# Altium schematic sheet RGB_Breakout.SchDoc: Apalis Evaluation Board 1.1
size A3; Organization: Toradex AG; Address1: Altsagenstrasse 5; Address2: Horw; Address3: 6048; Address4: Switzerland; DocumentNumber: 17; Revision: V1.1; SheetNumber: 17; SheetTotal: 32; PageSetup: Record=PageOptions|CenterHorizontal=True|CenterVertical=True|PrintScale=0.73|XCorrection=1.00|YCorrection=1.00|PrintKind=0|BorderSize=5000000|LeftOffset=0|BottomOffset=0|Orientation=2|PaperLength=1000|PaperWidth=1000|Scale=100|PaperSource=7|PrintQuality=-4|MediaType=1|DitherType=10|PaperKind=A4|PrintScaleMode=1
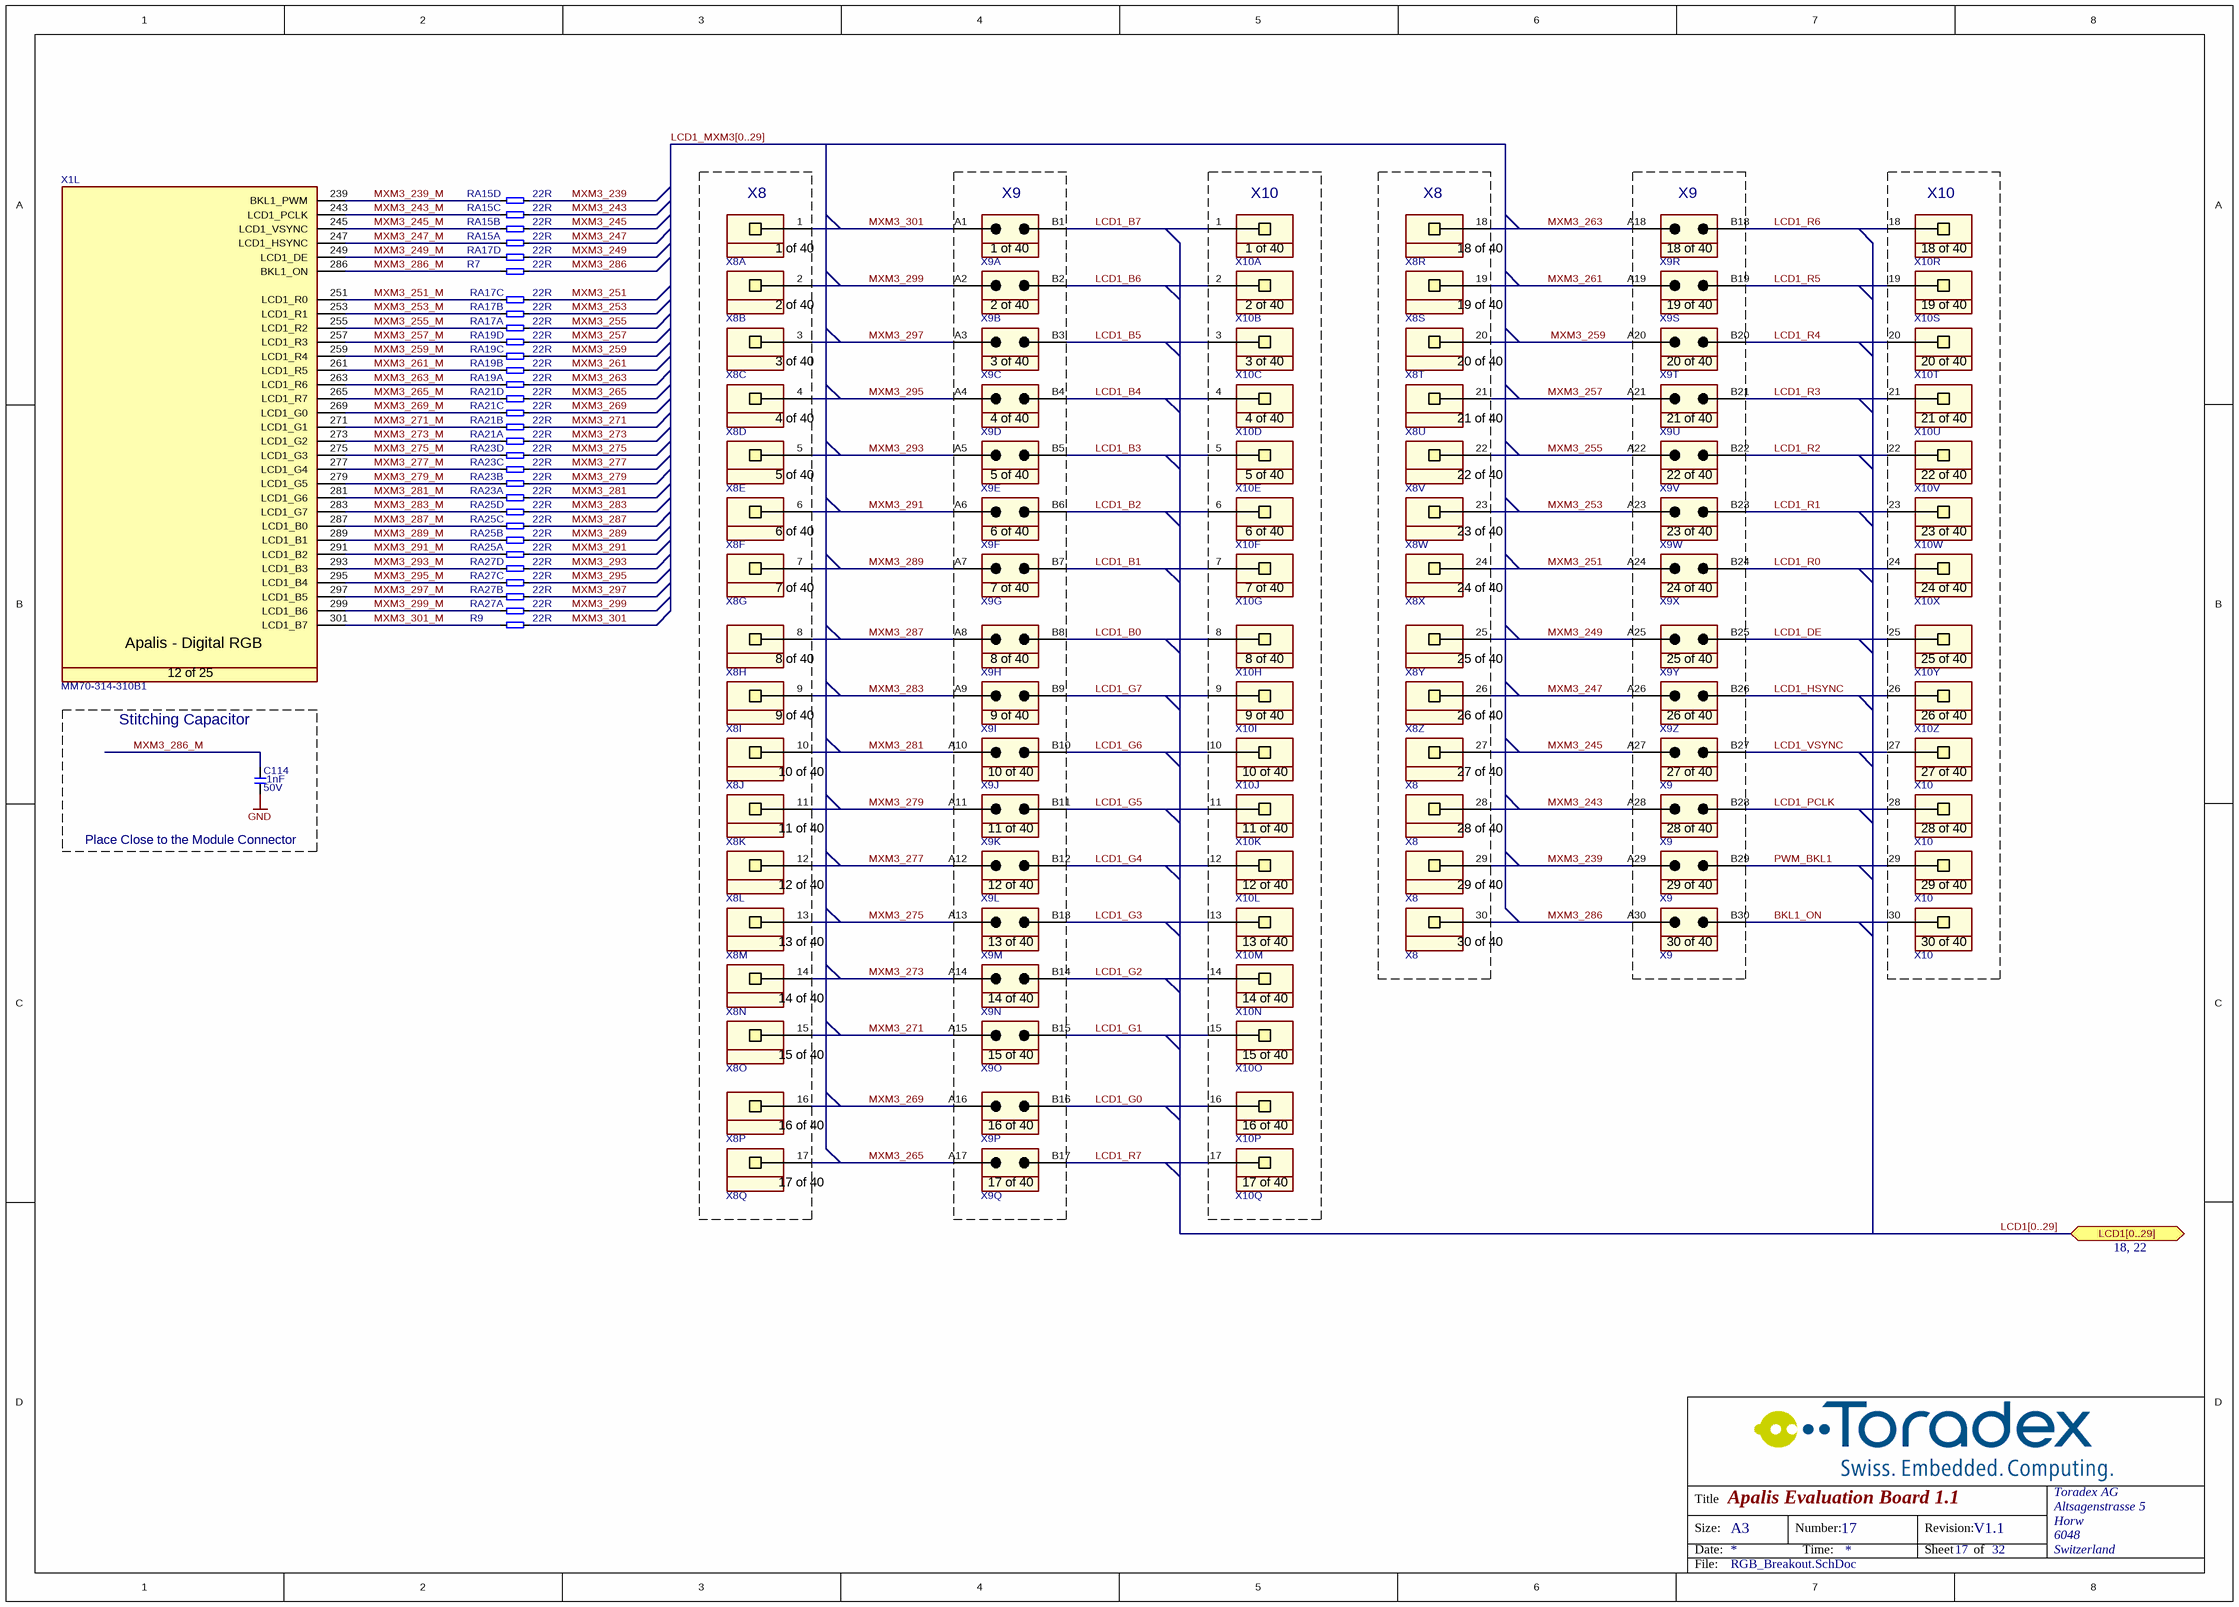
[diagram p0: RGB_Breakout.SchDoc]

## Parts
C114  Rating: 50V  [CAPC1005X60N]  (hidden comment: 1nF)
R7  22R  [RESC1005X40N]
R9  22R  [T_RESC0603X30N]
RA15  22R  [T_Resistor_Array_X4]  (parts A,B,C,D of 4)
RA17  22R  [T_Resistor_Array_X4]  (parts A,B,C,D of 4)
RA19  22R  [T_Resistor_Array_X4]  (parts A,B,C,D of 4)
RA21  22R  [T_Resistor_Array_X4]  (parts A,B,C,D of 4)
RA23  22R  [T_Resistor_Array_X4]  (parts A,B,C,D of 4)
RA25  22R  [T_Resistor_Array_X4]  (parts A,B,C,D of 4)
RA27  22R  [T_Resistor_Array_X4]  (parts A,B,C,D of 4)
X1  Manufacturer Part No.: MM70-314-310B1  [T_JAE_MM70-314-310B1]  (hidden comment: CON-JAE-MM70-314-310B1-314-0.5mm)  (part L of 25)
X8  SSW-110-01-G-S  [T_Samtec_SSW-110-01-G-S]  (value not drawn)  (parts A,B,C,D,E,F,G,H,I,J,K,L,M,N,O,P,Q,R,S,T,U,V,W,X,Y,Z,27,28,29,30 of 40)
X9  TSW-110-07-G-D  [T_Samtec_TSW-110-07-G-D]  (value not drawn)  (parts A,B,C,D,E,F,G,H,I,J,K,L,M,N,O,P,Q,R,S,T,U,V,W,X,Y,Z,27,28,29,30 of 40)
X10  SSW-110-01-G-S  [T_Samtec_SSW-110-01-G-S]  (value not drawn)  (parts A,B,C,D,E,F,G,H,I,J,K,L,M,N,O,P,Q,R,S,T,U,V,W,X,Y,Z,27,28,29,30 of 40)

## Blocks framed on the sheet
X8: X8
X9: X9
X10: X10
X8: X8
X9: X9
X10: X10
Stitching Capacitor: C114

## Ports
LCD1[0..29] (bidir, see 18, 22)

## Nets
GND: C114.1
BKL1_ON: X9.B30 X10.30
LCD1_B0: X9.B8 X10.8
LCD1_B1: X9.B7 X10.7
LCD1_B2: X9.B6 X10.6
LCD1_B3: X9.B5 X10.5
LCD1_B4: X9.B4 X10.4
LCD1_B5: X9.B3 X10.3
LCD1_B6: X9.B2 X10.2
LCD1_B7: X9.B1 X10.1
LCD1_DE: X9.B25 X10.25
LCD1_G0: X9.B16 X10.16
LCD1_G1: X9.B15 X10.15
LCD1_G2: X9.B14 X10.14
LCD1_G3: X9.B13 X10.13
LCD1_G4: X9.B12 X10.12
LCD1_G5: X9.B11 X10.11
LCD1_G6: X9.B10 X10.10
LCD1_G7: X9.B9 X10.9
LCD1_HSYNC: X9.B26 X10.26
LCD1_PCLK: X9.B28 X10.28
LCD1_R0: X9.B24 X10.24
LCD1_R1: X9.B23 X10.23
LCD1_R2: X9.B22 X10.22
LCD1_R3: X9.B21 X10.21
LCD1_R4: X9.B20 X10.20
LCD1_R5: X9.B19 X10.19
LCD1_R6: X9.B18 X10.18
LCD1_R7: X9.B17 X10.17
LCD1_VSYNC: X9.B27 X10.27
MXM3_239: RA15.8 X8.29 X9.A29
MXM3_239_M: RA15.4 X1.239(BKL1_PWM)
MXM3_243: RA15.7 X8.28 X9.A28
MXM3_243_M: RA15.3 X1.243(LCD1_PCLK)
MXM3_245: RA15.6 X8.27 X9.A27
MXM3_245_M: RA15.2 X1.245(LCD1_VSYNC)
MXM3_247: RA15.5 X8.26 X9.A26
MXM3_247_M: RA15.1 X1.247(LCD1_HSYNC)
MXM3_249: RA17.8 X8.25 X9.A25
MXM3_249_M: RA17.4 X1.249(LCD1_DE)
MXM3_251: RA17.7 X8.24 X9.A24
MXM3_251_M: RA17.3 X1.251(LCD1_R0)
MXM3_253: RA17.6 X8.23 X9.A23
MXM3_253_M: RA17.2 X1.253(LCD1_R1)
MXM3_255: RA17.5 X8.22 X9.A22
MXM3_255_M: RA17.1 X1.255(LCD1_R2)
MXM3_257: RA19.8 X8.21 X9.A21
MXM3_257_M: RA19.4 X1.257(LCD1_R3)
MXM3_259: RA19.7 X8.20 X9.A20
MXM3_259_M: RA19.3 X1.259(LCD1_R4)
MXM3_261: RA19.6 X8.19 X9.A19
MXM3_261_M: RA19.2 X1.261(LCD1_R5)
MXM3_263: RA19.5 X8.18 X9.A18
MXM3_263_M: RA19.1 X1.263(LCD1_R6)
MXM3_265: RA21.8 X8.17 X9.A17
MXM3_265_M: RA21.4 X1.265(LCD1_R7)
MXM3_269: RA21.7 X8.16 X9.A16
MXM3_269_M: RA21.3 X1.269(LCD1_G0)
MXM3_271: RA21.6 X8.15 X9.A15
MXM3_271_M: RA21.2 X1.271(LCD1_G1)
MXM3_273: RA21.5 X8.14 X9.A14
MXM3_273_M: RA21.1 X1.273(LCD1_G2)
MXM3_275: RA23.8 X8.13 X9.A13
MXM3_275_M: RA23.4 X1.275(LCD1_G3)
MXM3_277: RA23.7 X8.12 X9.A12
MXM3_277_M: RA23.3 X1.277(LCD1_G4)
MXM3_279: RA23.6 X8.11 X9.A11
MXM3_279_M: RA23.2 X1.279(LCD1_G5)
MXM3_281: RA23.5 X8.10 X9.A10
MXM3_281_M: RA23.1 X1.281(LCD1_G6)
MXM3_283: RA25.8 X8.9 X9.A9
MXM3_283_M: RA25.4 X1.283(LCD1_G7)
MXM3_286: R7.2 X8.30 X9.A30
MXM3_286_M: C114.2 R7.1 X1.286(BKL1_ON)
MXM3_287: RA25.7 X8.8 X9.A8
MXM3_287_M: RA25.3 X1.287(LCD1_B0)
MXM3_289: RA25.6 X8.7 X9.A7
MXM3_289_M: RA25.2 X1.289(LCD1_B1)
MXM3_291: RA25.5 X8.6 X9.A6
MXM3_291_M: RA25.1 X1.291(LCD1_B2)
MXM3_293: RA27.8 X8.5 X9.A5
MXM3_293_M: RA27.4 X1.293(LCD1_B3)
MXM3_295: RA27.7 X8.4 X9.A4
MXM3_295_M: RA27.3 X1.295(LCD1_B4)
MXM3_297: RA27.6 X8.3 X9.A3
MXM3_297_M: RA27.2 X1.297(LCD1_B5)
MXM3_299: RA27.5 X8.2 X9.A2
MXM3_299_M: RA27.1 X1.299(LCD1_B6)
MXM3_301: R9.2 X8.1 X9.A1
MXM3_301_M: R9.1 X1.301(LCD1_B7)
PWM_BKL1: X9.B29 X10.29

## Buses and harness runs
bus LCD1[0..29] = port LCD1[0..29]
bus LCD1_MXM3[0..29]

## Notes on the sheet
- (near C114) Place Close to the Module Connector
- Title
- Size:
- Date:
- A3
- Number:
- Time:
- Revision:
- Sheet
- of
- File:
- (in symbol CON-JAE-MM70-314-310B1-314-0.5mm, part L) Apalis - Digital RGB; 12 of 25
- (in symbol CON-Samtec-SSW-110-01-G-S, part A) 1 of 40
- (in symbol CON-Samtec-SSW-110-01-G-S, part B) 2 of 40
- (in symbol CON-Samtec-SSW-110-01-G-S, part C) 3 of 40
- (in symbol CON-Samtec-SSW-110-01-G-S, part D) 4 of 40
- (in symbol CON-Samtec-SSW-110-01-G-S, part E) 5 of 40
- (in symbol CON-Samtec-SSW-110-01-G-S, part F) 6 of 40
- (in symbol CON-Samtec-SSW-110-01-G-S, part G) 7 of 40
- (in symbol CON-Samtec-SSW-110-01-G-S, part H) 8 of 40
- (in symbol CON-Samtec-SSW-110-01-G-S, part I) 9 of 40
- (in symbol CON-Samtec-SSW-110-01-G-S, part J) 10 of 40
- (in symbol CON-Samtec-SSW-110-01-G-S, part K) 11 of 40
- (in symbol CON-Samtec-SSW-110-01-G-S, part L) 12 of 40
- (in symbol CON-Samtec-SSW-110-01-G-S, part M) 13 of 40
- (in symbol CON-Samtec-SSW-110-01-G-S, part N) 14 of 40
- (in symbol CON-Samtec-SSW-110-01-G-S, part O) 15 of 40
- (in symbol CON-Samtec-SSW-110-01-G-S, part P) 16 of 40
- (in symbol CON-Samtec-SSW-110-01-G-S, part Q) 17 of 40
- (in symbol CON-Samtec-SSW-110-01-G-S, part R) 18 of 40
- (in symbol CON-Samtec-SSW-110-01-G-S, part S) 19 of 40
- (in symbol CON-Samtec-SSW-110-01-G-S, part T) 20 of 40
- (in symbol CON-Samtec-SSW-110-01-G-S, part U) 21 of 40
- (in symbol CON-Samtec-SSW-110-01-G-S, part V) 22 of 40
- (in symbol CON-Samtec-SSW-110-01-G-S, part W) 23 of 40
- (in symbol CON-Samtec-SSW-110-01-G-S, part X) 24 of 40
- (in symbol CON-Samtec-SSW-110-01-G-S, part Y) 25 of 40
- (in symbol CON-Samtec-SSW-110-01-G-S, part Z) 26 of 40
- (in symbol CON-Samtec-SSW-110-01-G-S, part 27) 27 of 40
- (in symbol CON-Samtec-SSW-110-01-G-S, part 28) 28 of 40
- (in symbol CON-Samtec-SSW-110-01-G-S, part 29) 29 of 40
- (in symbol CON-Samtec-SSW-110-01-G-S, part 30) 30 of 40
- (in symbol CON-Samtec-TSW-110-07-G-D, part A) 1 of 40
- (in symbol CON-Samtec-TSW-110-07-G-D, part B) 2 of 40
- (in symbol CON-Samtec-TSW-110-07-G-D, part C) 3 of 40
- (in symbol CON-Samtec-TSW-110-07-G-D, part D) 4 of 40
- (in symbol CON-Samtec-TSW-110-07-G-D, part E) 5 of 40
- (in symbol CON-Samtec-TSW-110-07-G-D, part F) 6 of 40
- (in symbol CON-Samtec-TSW-110-07-G-D, part G) 7 of 40
- (in symbol CON-Samtec-TSW-110-07-G-D, part H) 8 of 40
- (in symbol CON-Samtec-TSW-110-07-G-D, part I) 9 of 40
- (in symbol CON-Samtec-TSW-110-07-G-D, part J) 10 of 40
- (in symbol CON-Samtec-TSW-110-07-G-D, part K) 11 of 40
- (in symbol CON-Samtec-TSW-110-07-G-D, part L) 12 of 40
- (in symbol CON-Samtec-TSW-110-07-G-D, part M) 13 of 40
- (in symbol CON-Samtec-TSW-110-07-G-D, part N) 14 of 40
- (in symbol CON-Samtec-TSW-110-07-G-D, part O) 15 of 40
- (in symbol CON-Samtec-TSW-110-07-G-D, part P) 16 of 40
- (in symbol CON-Samtec-TSW-110-07-G-D, part Q) 17 of 40
- (in symbol CON-Samtec-TSW-110-07-G-D, part R) 18 of 40
- (in symbol CON-Samtec-TSW-110-07-G-D, part S) 19 of 40
- (in symbol CON-Samtec-TSW-110-07-G-D, part T) 20 of 40
- (in symbol CON-Samtec-TSW-110-07-G-D, part U) 21 of 40
- (in symbol CON-Samtec-TSW-110-07-G-D, part V) 22 of 40
- (in symbol CON-Samtec-TSW-110-07-G-D, part W) 23 of 40
- (in symbol CON-Samtec-TSW-110-07-G-D, part X) 24 of 40
- (in symbol CON-Samtec-TSW-110-07-G-D, part Y) 25 of 40
- (in symbol CON-Samtec-TSW-110-07-G-D, part Z) 26 of 40
- (in symbol CON-Samtec-TSW-110-07-G-D, part 27) 27 of 40
- (in symbol CON-Samtec-TSW-110-07-G-D, part 28) 28 of 40
- (in symbol CON-Samtec-TSW-110-07-G-D, part 29) 29 of 40
- (in symbol CON-Samtec-TSW-110-07-G-D, part 30) 30 of 40

## Library data of the parts
C114 = C-X7R-1nF-50V-10%-0402: Capacitor Ceramic X7R 1nF 50V 10% 0402; Tolerance: 10%; Type: X7R; Value: 1nF
R7 = R-22R-63mW-5%-0402: Resistor 22 ohm 63mW 5% 0402; Rating: 63mW; Tolerance: 5%; Value: 22R
R9 = R-22R-63mW-5%-0603: Resistor 22 ohm 63mW 5% 0603; Rating: 63mW; Tolerance: 5%; Value: 22R
RA15 RA17 RA19 RA21 RA23 RA25 RA27 = RA-22R-63mW-5%-1206-div: Resistor Array 22 R 63mW 5% 1206; Tolerance: 5%; Power Dissipation: 63mW; Value: 22R
X1 = CON-JAE-MM70-314-310B1-314-0.5mm: MXM3 Connector; Manufacturer Name: JAE; No. of ways: 314
X8 X10 = CON-Samtec-SSW-110-01-G-S: Receptacle Female Socket 1x40 pin 2.54mm pitch; Manufacturer Name: Samtec; Pitch: 2.54mm; No. of ways: 1x40; Manufacturer Part No.: SSW-110-01-G-S
X9 = CON-Samtec-TSW-110-07-G-D: Header 2x40 pin 2.54mm pitch; Manufacturer Name: Samtec; Pitch: 2.54mm; No. of ways: 2x40; Manufacturer Part No.: TSW-110-07-G-D